# EasyEDA Pro project MushIO_V1p0_Final.eprj, schematic MushIO_V1p0_Final (continued)
## Sheets (continued)
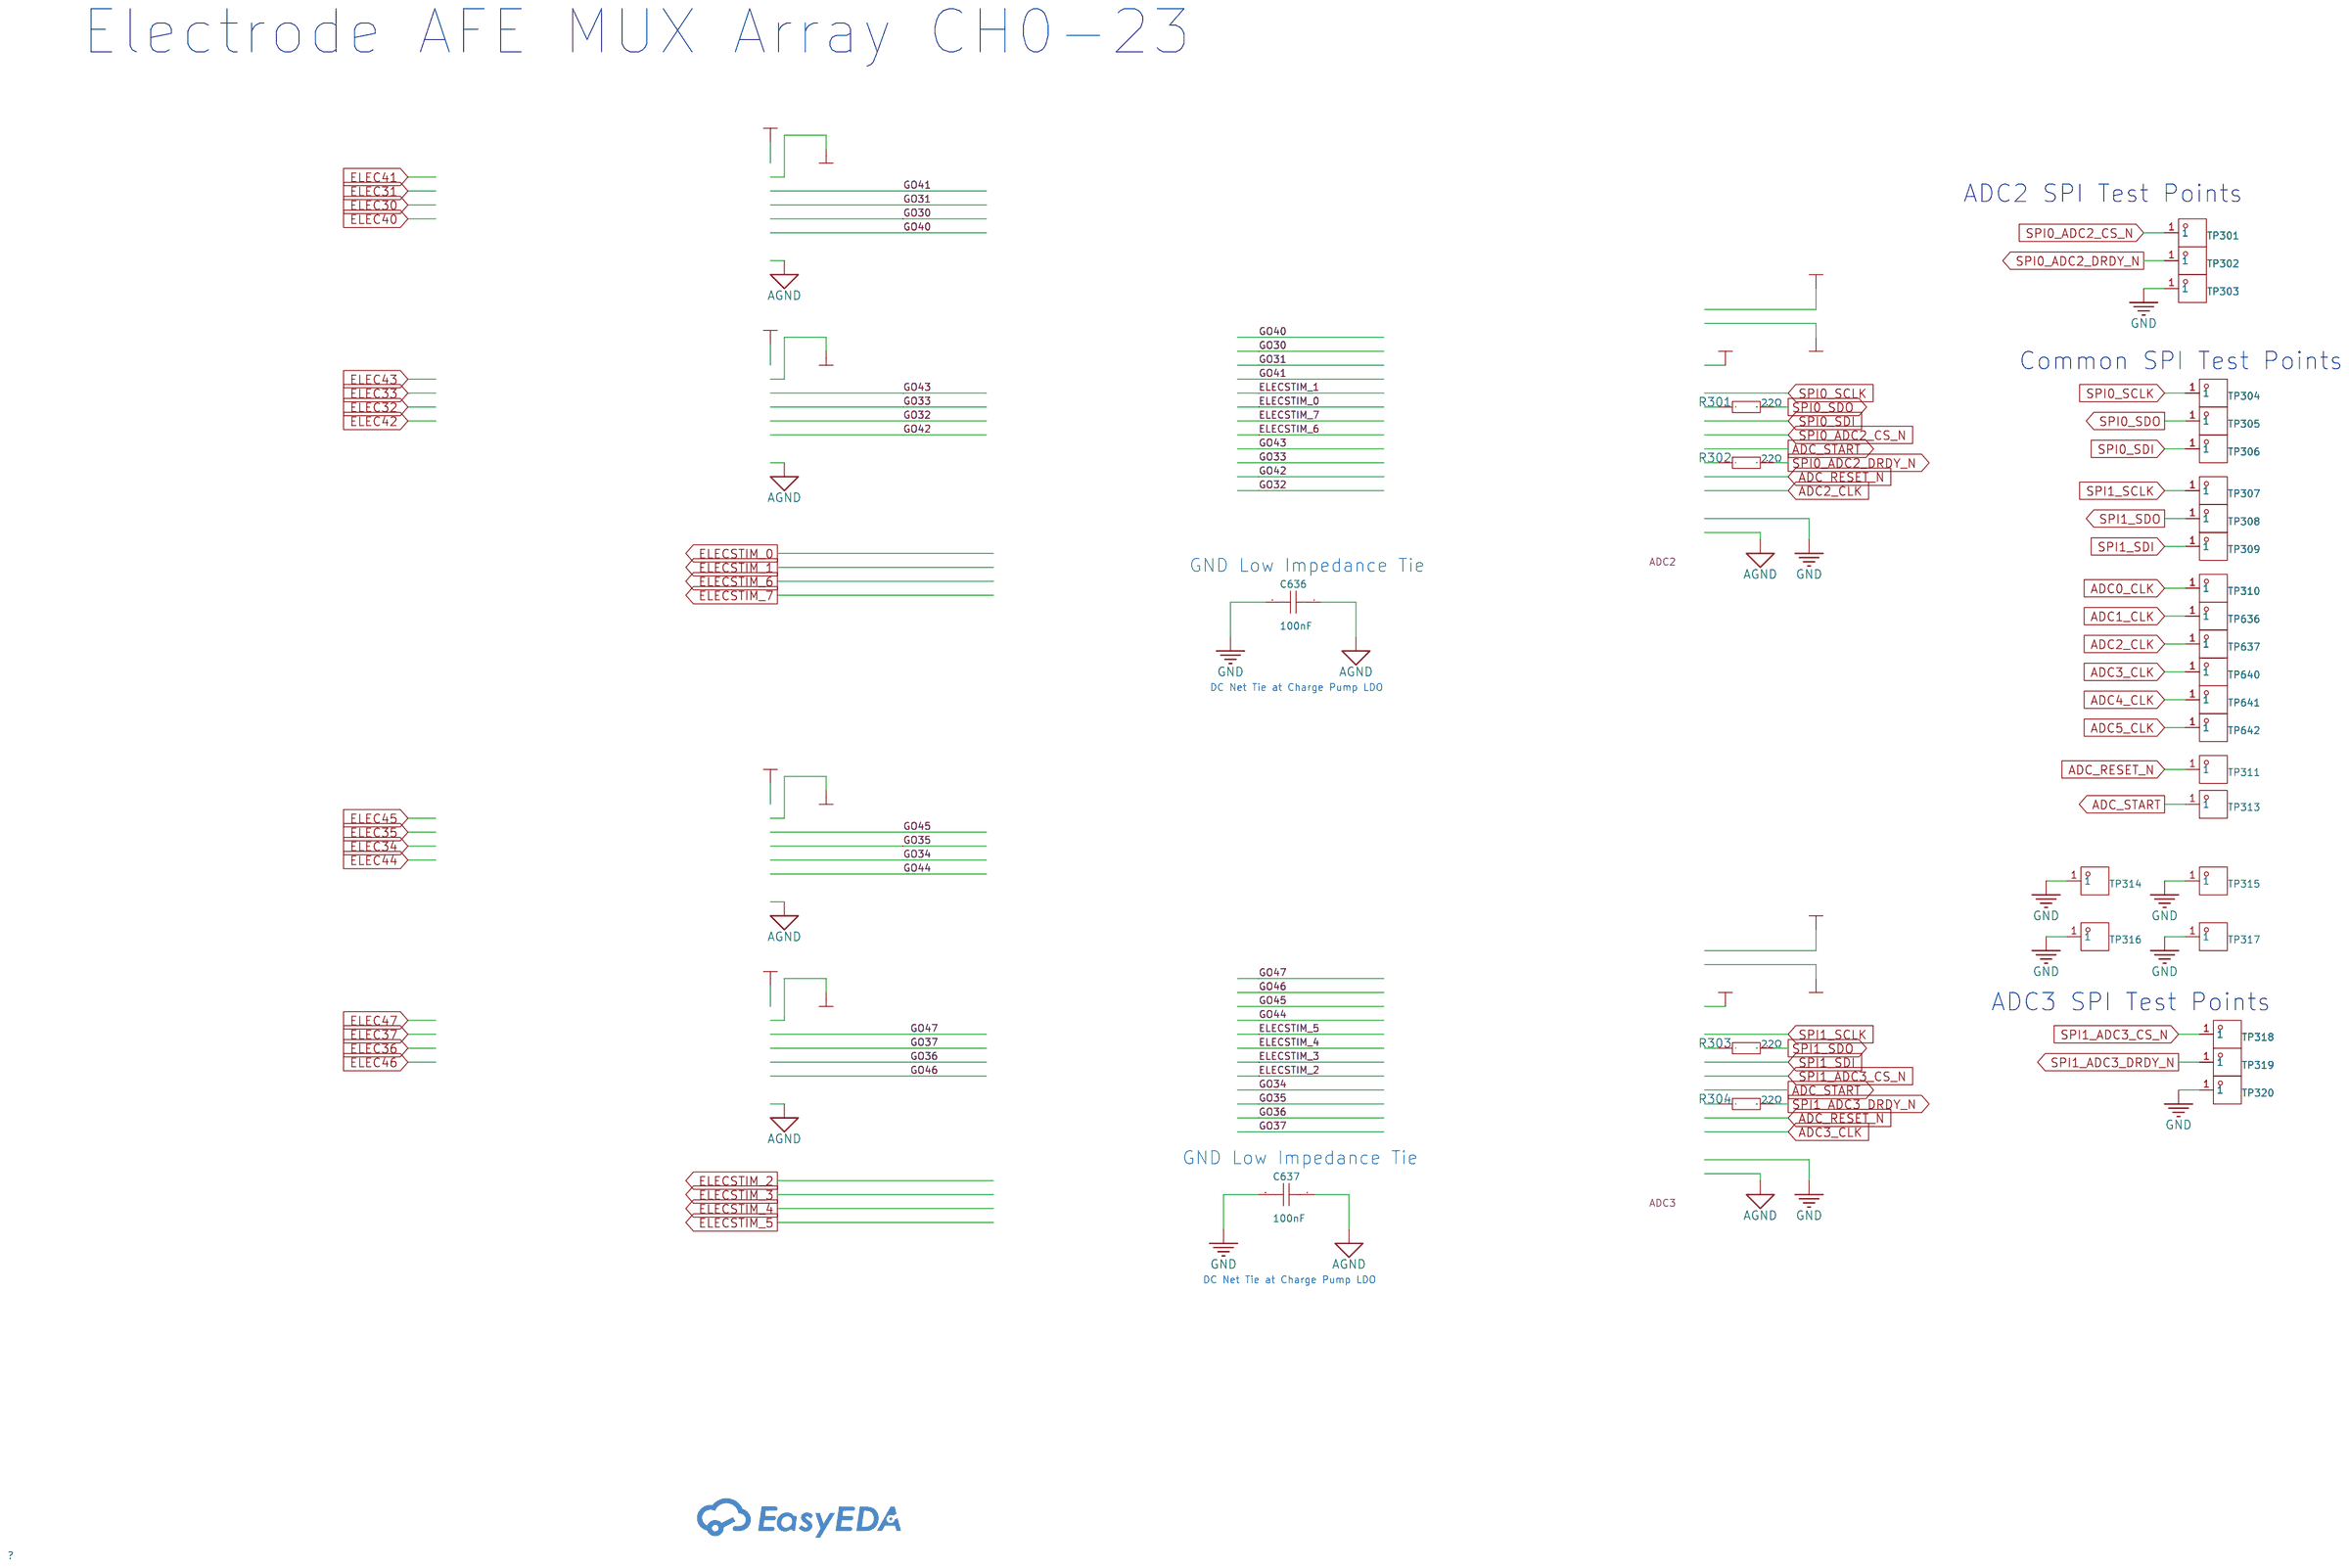
[diagram p6: AFE_ADC23]
6 AFE_ADC45: Board Name: MushIO_V1p2; Create Date: 2025-11-03; Page Name: AFE_ADC45; Project Name: MushIO_V1p2; Schematic Name: MushIO_V1p2; Update Date: 2025-12-31
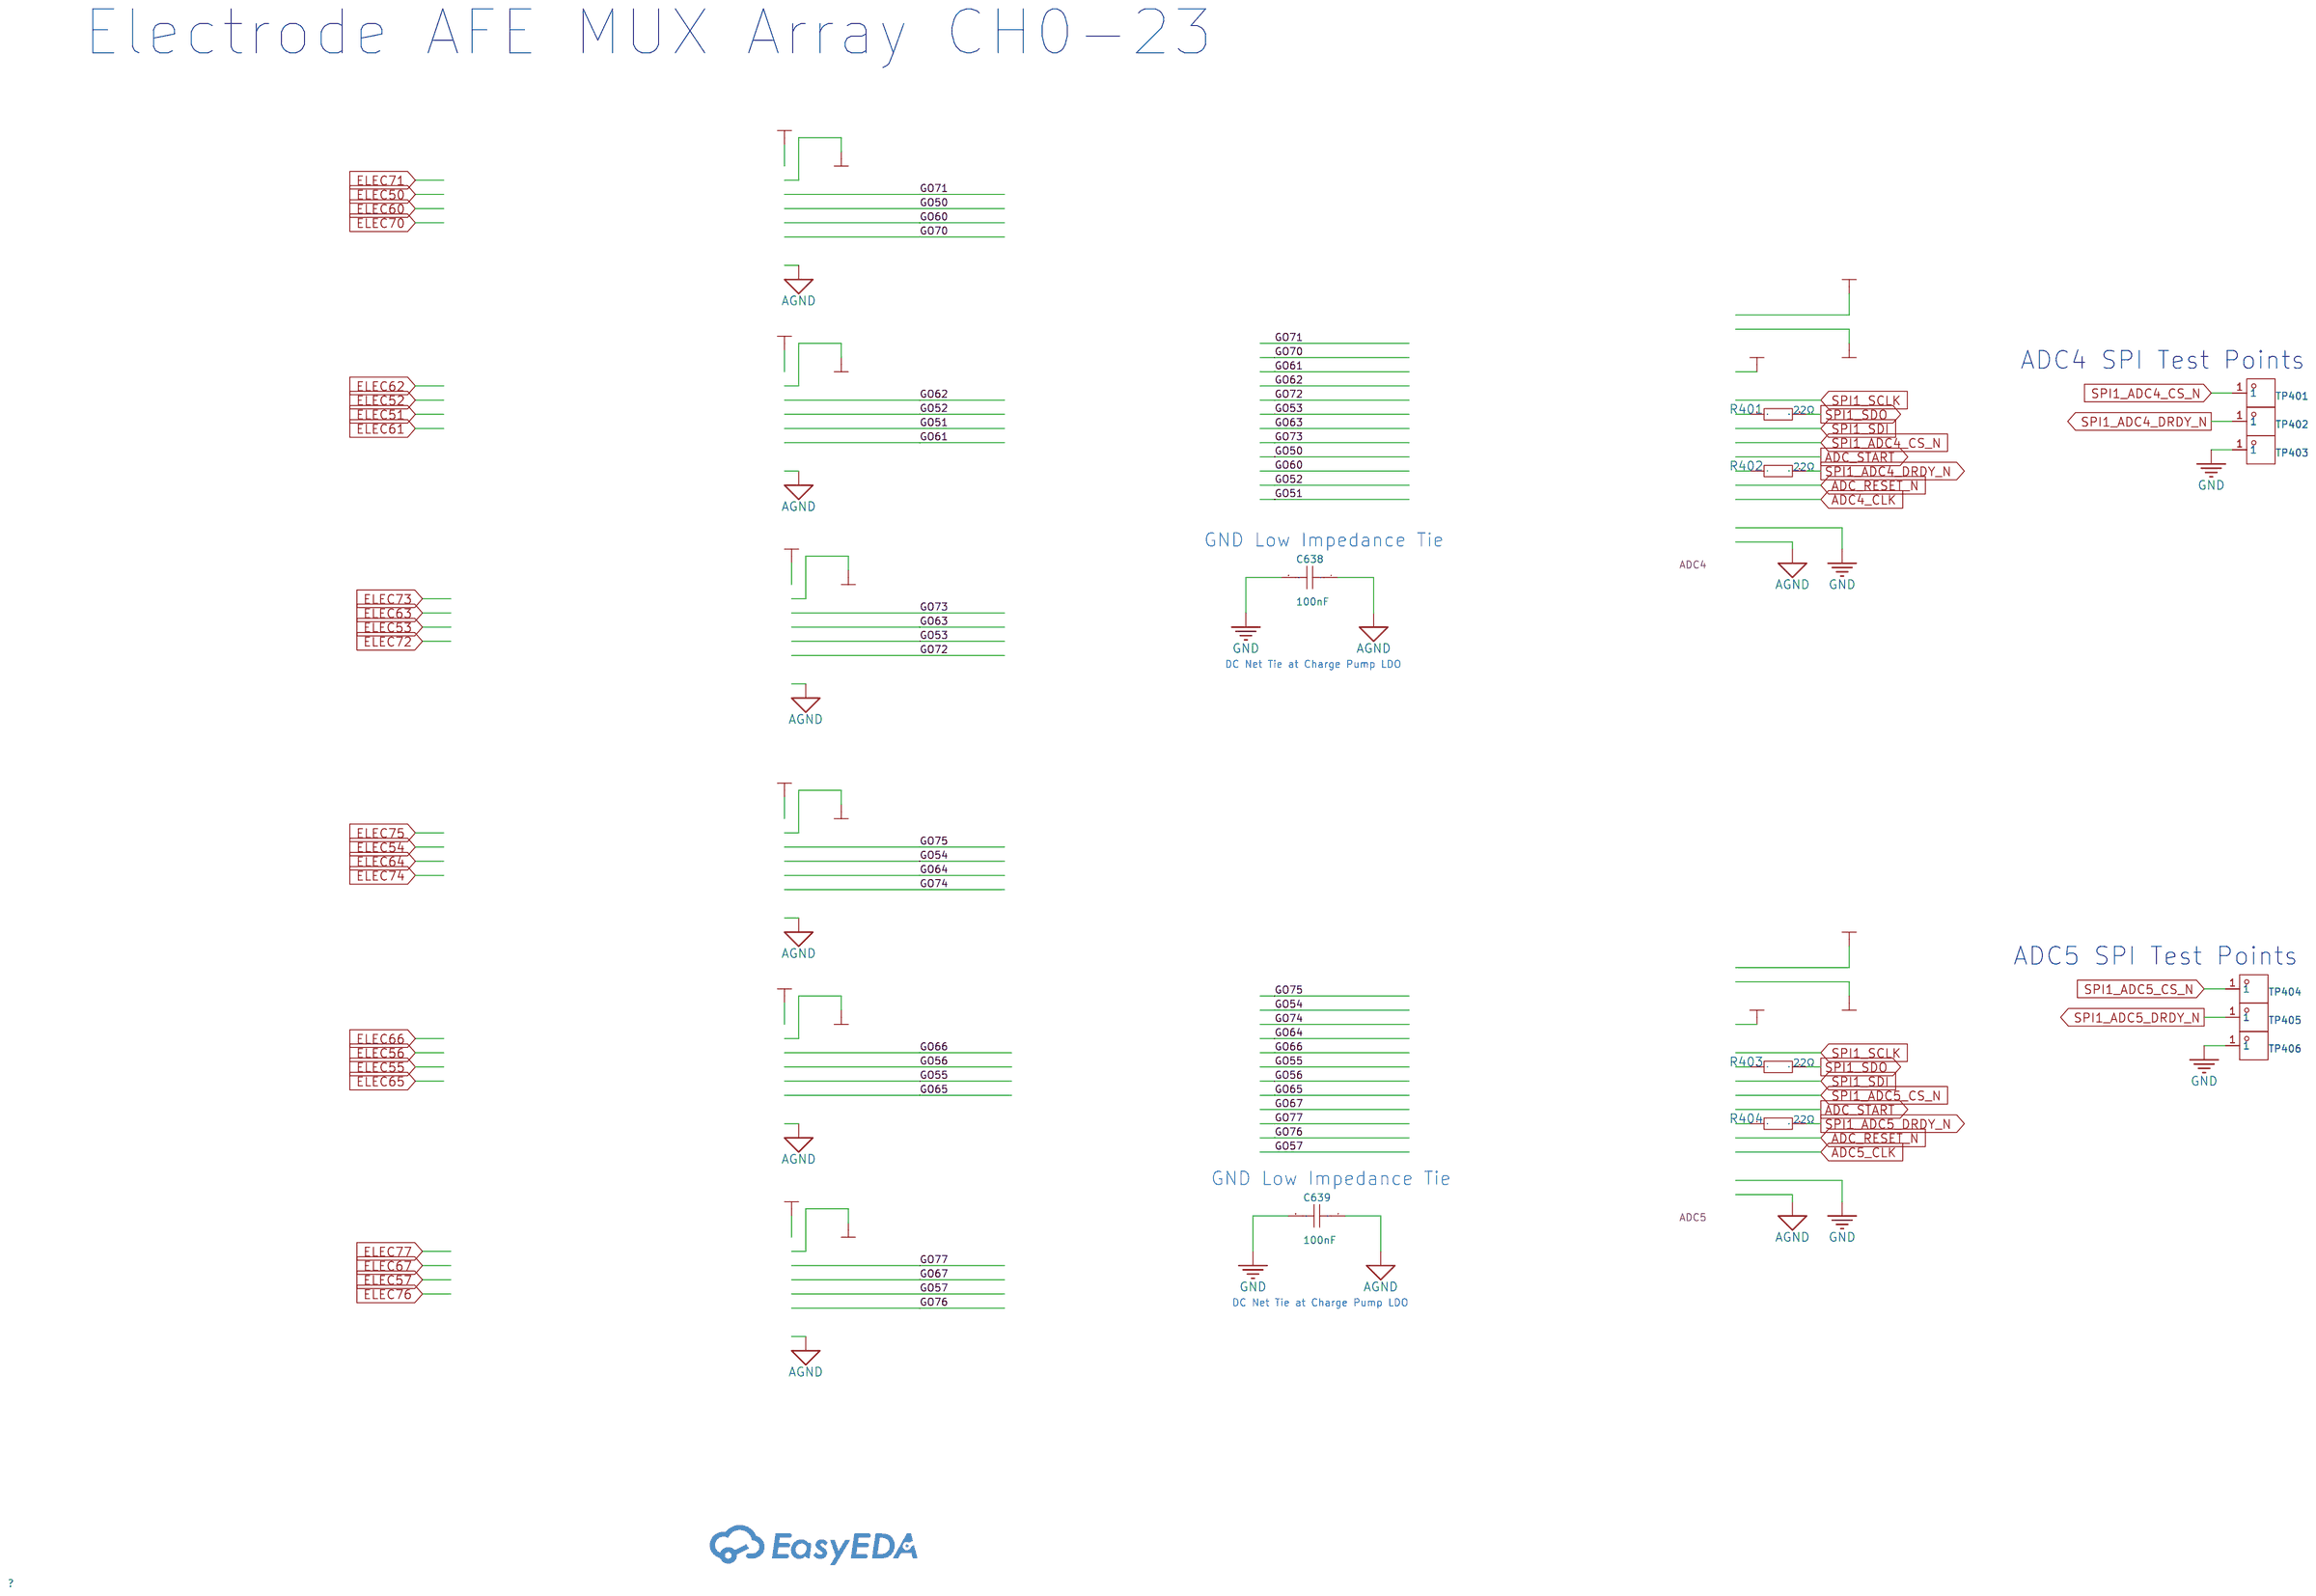
[diagram p7: AFE_ADC45]
7 Raspberry Pi Pico W: Page Name: Raspberry Pi Pico W
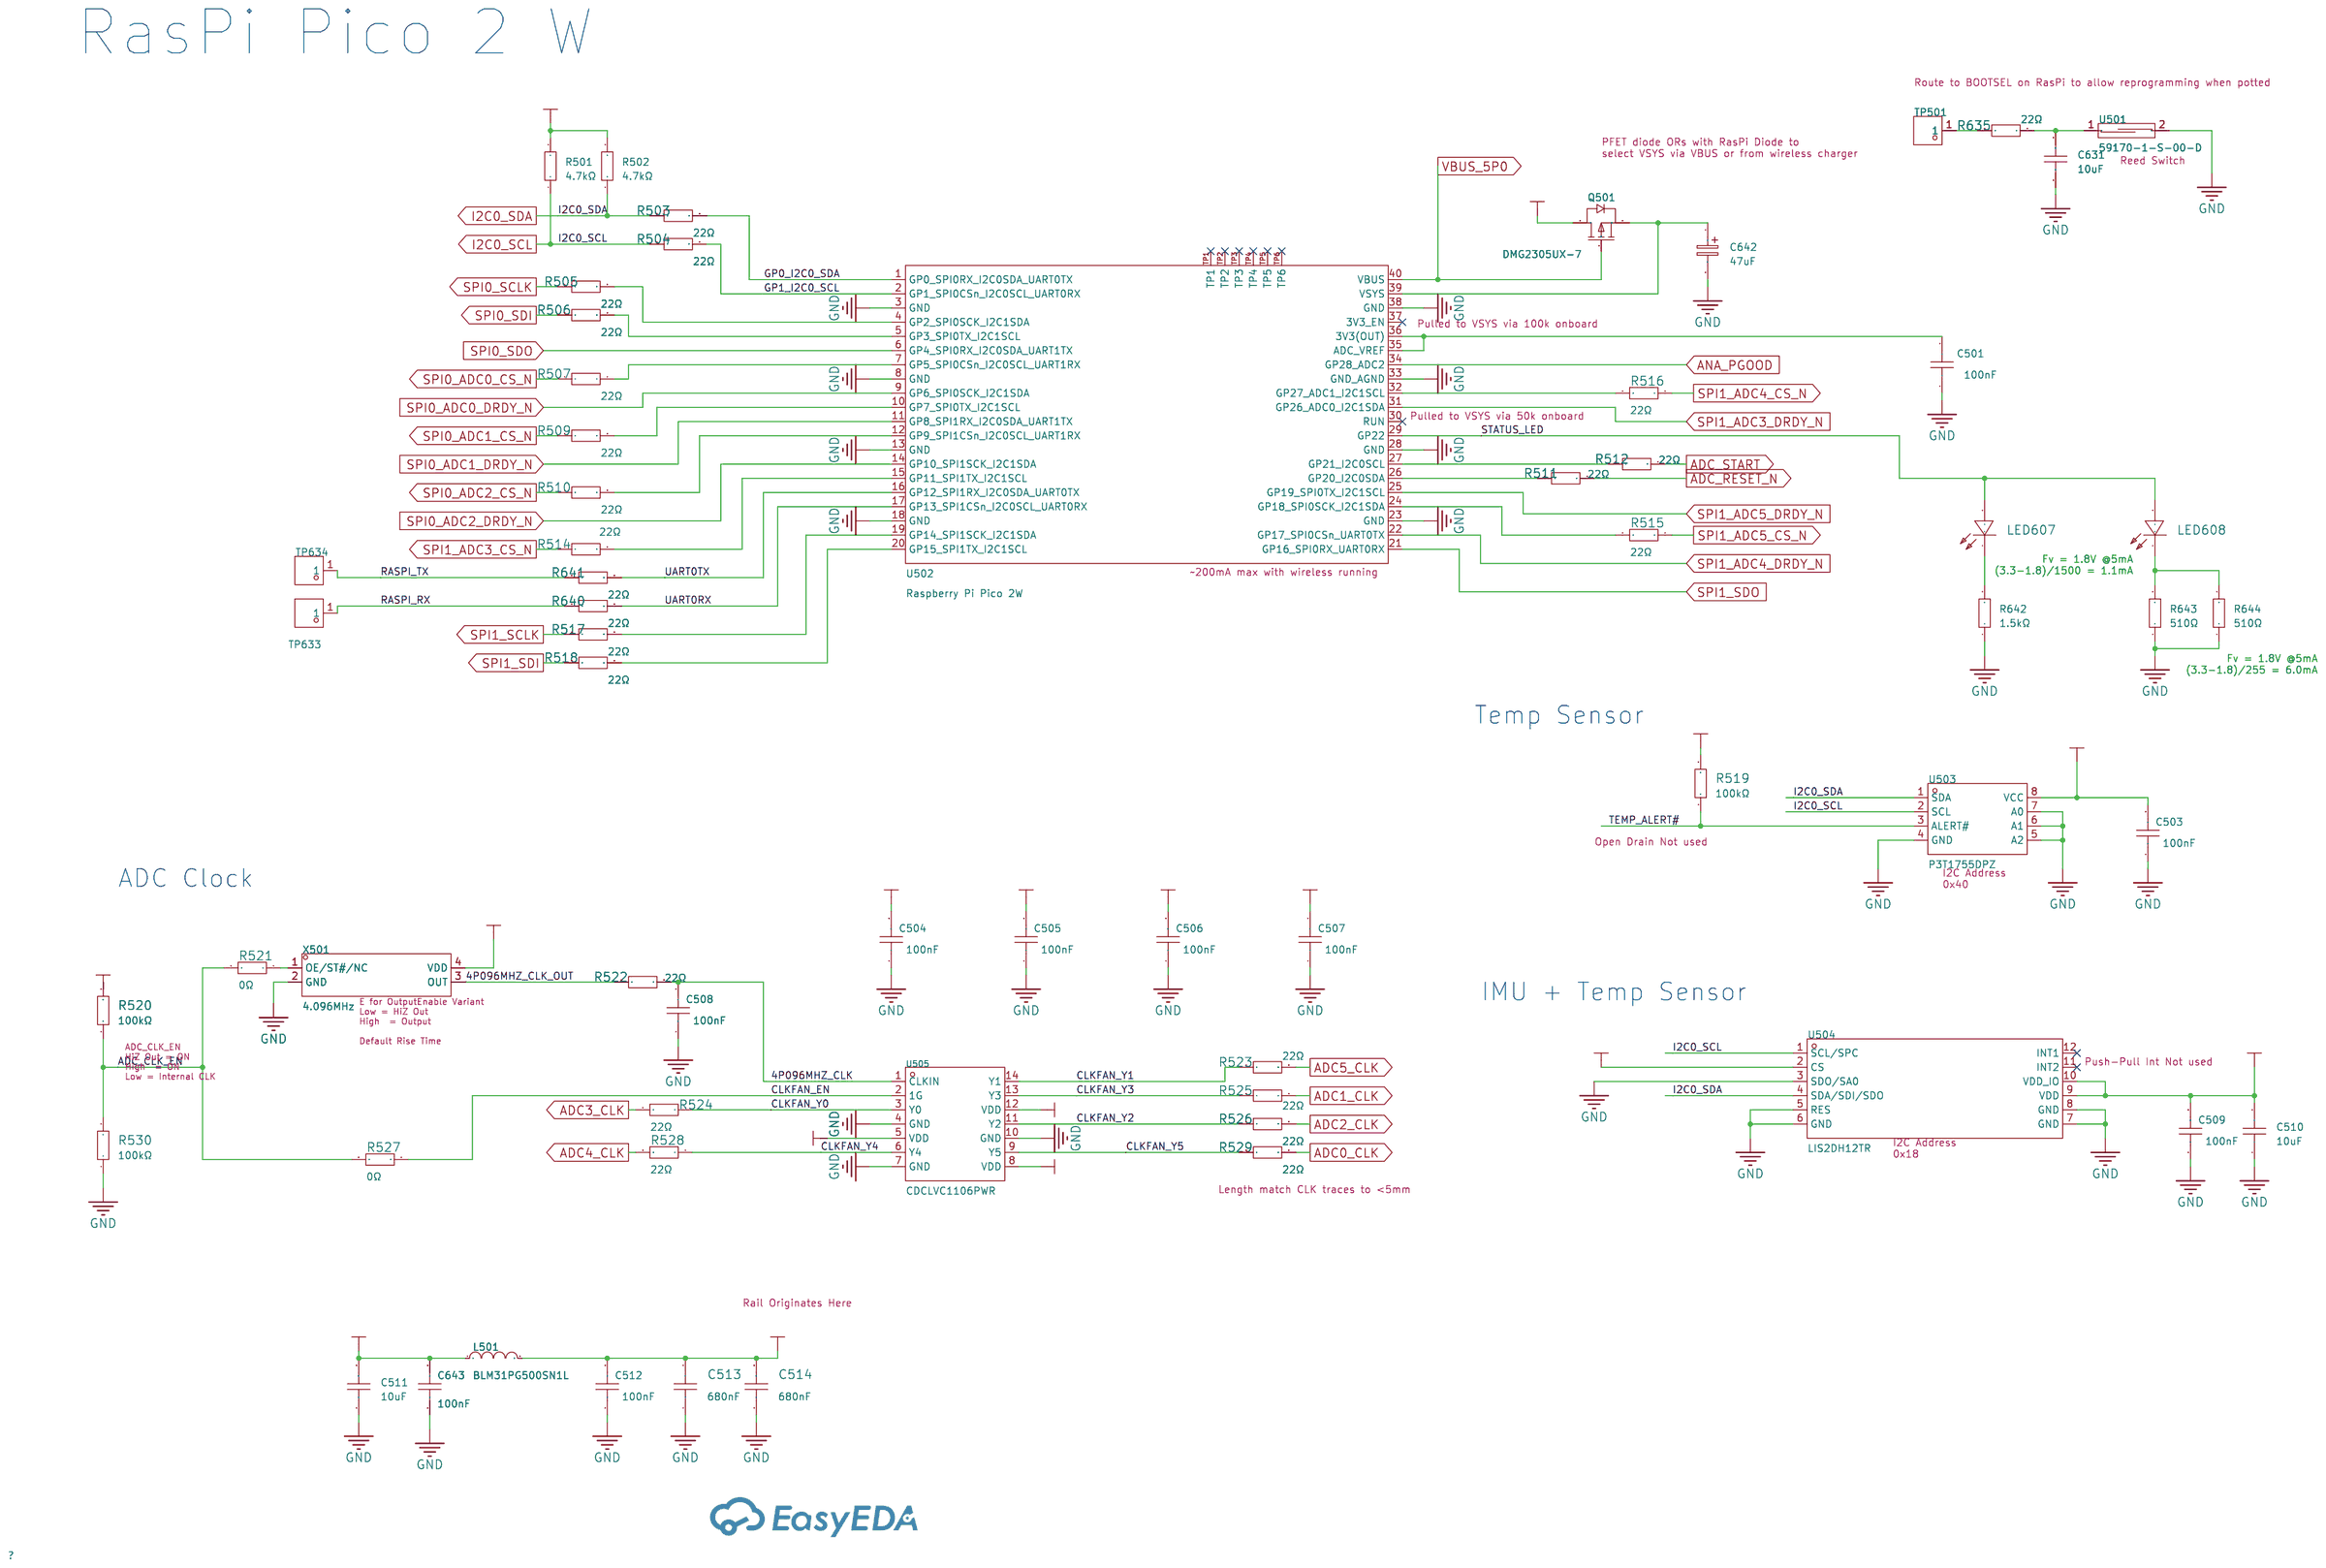
[diagram p8: Raspberry Pi Pico W]

## Parts
sheet AFE_ADC01
C634  100nF  [C0402]
C635  100nF  [C0402]
CBB1  -
CBB2  -
CBB3  -
CBB4  -
CBB5  -
CBB6  -
CBB7  -
CBB8  -
R201  22Ω  [R0402]
R202  22Ω  [R0402]
R203  22Ω  [R0402]
R204  22Ω  [R0402]
TP201  RCUCTE  [TP-SMD_RCUCTE]
TP202  RCUCTE  [TP-SMD_RCUCTE]
TP203  RCUCTE  [TP-SMD_RCUCTE]
TP204  RCUCTE  [TP-SMD_RCUCTE]
TP205  RCUCTE  [TP-SMD_RCUCTE]
TP206  RCUCTE  [TP-SMD_RCUCTE]
sheet AFE_ADC23
C636  100nF  [C0402]
C637  100nF  [C0402]
CBB9  -
CBB10  -
CBB14  -
CBB15  -
CBB18  -
CBB19  -
R301  22Ω  [R0402]
R302  22Ω  [R0402]
R303  22Ω  [R0402]
R304  22Ω  [R0402]
TP301  RCUCTE  [TP-SMD_RCUCTE]
TP302  RCUCTE  [TP-SMD_RCUCTE]
TP303  RCUCTE  [TP-SMD_RCUCTE]
TP304  RCUCTE  [TP-SMD_RCUCTE]
TP305  RCUCTE  [TP-SMD_RCUCTE]
TP306  RCUCTE  [TP-SMD_RCUCTE]
TP307  RCUCTE  [TP-SMD_RCUCTE]
TP308  RCUCTE  [TP-SMD_RCUCTE]
TP309  RCUCTE  [TP-SMD_RCUCTE]
TP310  RCUCTE  [TP-SMD_RCUCTE]
TP311  RCUCTE  [TP-SMD_RCUCTE]
TP313  RCUCTE  [TP-SMD_RCUCTE]
TP314  RCUCTE  [TP-SMD_RCUCTE]
TP315  RCUCTE  [TP-SMD_RCUCTE]
TP316  RCUCTE  [TP-SMD_RCUCTE]
TP317  RCUCTE  [TP-SMD_RCUCTE]
TP318  RCUCTE  [TP-SMD_RCUCTE]
TP319  RCUCTE  [TP-SMD_RCUCTE]
TP320  RCUCTE  [TP-SMD_RCUCTE]
TP636  RCUCTE  [TP-SMD_RCUCTE]
TP637  RCUCTE  [TP-SMD_RCUCTE]
TP640  RCUCTE  [TP-SMD_RCUCTE]
TP641  RCUCTE  [TP-SMD_RCUCTE]
TP642  RCUCTE  [TP-SMD_RCUCTE]
sheet AFE_ADC45
C638  100nF  [C0402]
C639  100nF  [C0402]
CBB20  -
CBB21  -
CBB22  -
CBB23  -
CBB24  -
CBB25  -
CBB34  -
CBB35  -
R401  22Ω  [R0402]
R402  22Ω  [R0402]
R403  22Ω  [R0402]
R404  22Ω  [R0402]
TP401  RCUCTE  [TP-SMD_RCUCTE]
TP402  RCUCTE  [TP-SMD_RCUCTE]
TP403  RCUCTE  [TP-SMD_RCUCTE]
TP404  RCUCTE  [TP-SMD_RCUCTE]
TP405  RCUCTE  [TP-SMD_RCUCTE]
TP406  RCUCTE  [TP-SMD_RCUCTE]
sheet Electrodes
CN101  1508-0-00-15-00-00-03-0  [CONN-SMD_1508-0-00-15-00-00-03-0]
CN102  1508-0-00-15-00-00-03-0  [CONN-SMD_1508-0-00-15-00-00-03-0]
CN103  1508-0-00-15-00-00-03-0  [CONN-SMD_1508-0-00-15-00-00-03-0]
CN104  1508-0-00-15-00-00-03-0  [CONN-SMD_1508-0-00-15-00-00-03-0]
CN105  1508-0-00-15-00-00-03-0  [CONN-SMD_1508-0-00-15-00-00-03-0]
CN106  1508-0-00-15-00-00-03-0  [CONN-SMD_1508-0-00-15-00-00-03-0]
CN107  1508-0-00-15-00-00-03-0  [CONN-SMD_1508-0-00-15-00-00-03-0]
CN108  1508-0-00-15-00-00-03-0  [CONN-SMD_1508-0-00-15-00-00-03-0]
CN109  1508-0-00-15-00-00-03-0  [CONN-SMD_1508-0-00-15-00-00-03-0]
CN110  1508-0-00-15-00-00-03-0  [CONN-SMD_1508-0-00-15-00-00-03-0]
CN111  1508-0-00-15-00-00-03-0  [CONN-SMD_1508-0-00-15-00-00-03-0]
CN112  1508-0-00-15-00-00-03-0  [CONN-SMD_1508-0-00-15-00-00-03-0]
CN113  1508-0-00-15-00-00-03-0  [CONN-SMD_1508-0-00-15-00-00-03-0]
CN114  1508-0-00-15-00-00-03-0  [CONN-SMD_1508-0-00-15-00-00-03-0]
CN115  1508-0-00-15-00-00-03-0  [CONN-SMD_1508-0-00-15-00-00-03-0]
CN116  1508-0-00-15-00-00-03-0  [CONN-SMD_1508-0-00-15-00-00-03-0]
CN117  1508-0-00-15-00-00-03-0  [CONN-SMD_1508-0-00-15-00-00-03-0]
CN118  1508-0-00-15-00-00-03-0  [CONN-SMD_1508-0-00-15-00-00-03-0]
CN119  1508-0-00-15-00-00-03-0  [CONN-SMD_1508-0-00-15-00-00-03-0]
CN120  1508-0-00-15-00-00-03-0  [CONN-SMD_1508-0-00-15-00-00-03-0]
CN121  1508-0-00-15-00-00-03-0  [CONN-SMD_1508-0-00-15-00-00-03-0]
CN122  1508-0-00-15-00-00-03-0  [CONN-SMD_1508-0-00-15-00-00-03-0]
CN123  1508-0-00-15-00-00-03-0  [CONN-SMD_1508-0-00-15-00-00-03-0]
CN124  1508-0-00-15-00-00-03-0  [CONN-SMD_1508-0-00-15-00-00-03-0]
CN125  1508-0-00-15-00-00-03-0  [CONN-SMD_1508-0-00-15-00-00-03-0]
CN126  1508-0-00-15-00-00-03-0  [CONN-SMD_1508-0-00-15-00-00-03-0]
CN127  1508-0-00-15-00-00-03-0  [CONN-SMD_1508-0-00-15-00-00-03-0]
CN128  1508-0-00-15-00-00-03-0  [CONN-SMD_1508-0-00-15-00-00-03-0]
CN129  1508-0-00-15-00-00-03-0  [CONN-SMD_1508-0-00-15-00-00-03-0]
CN130  1508-0-00-15-00-00-03-0  [CONN-SMD_1508-0-00-15-00-00-03-0]
CN131  1508-0-00-15-00-00-03-0  [CONN-SMD_1508-0-00-15-00-00-03-0]
CN132  1508-0-00-15-00-00-03-0  [CONN-SMD_1508-0-00-15-00-00-03-0]
CN133  1508-0-00-15-00-00-03-0  [CONN-SMD_1508-0-00-15-00-00-03-0]
CN134  1508-0-00-15-00-00-03-0  [CONN-SMD_1508-0-00-15-00-00-03-0]
CN135  1508-0-00-15-00-00-03-0  [CONN-SMD_1508-0-00-15-00-00-03-0]
CN136  1508-0-00-15-00-00-03-0  [CONN-SMD_1508-0-00-15-00-00-03-0]
CN137  1508-0-00-15-00-00-03-0  [CONN-SMD_1508-0-00-15-00-00-03-0]
CN138  1508-0-00-15-00-00-03-0  [CONN-SMD_1508-0-00-15-00-00-03-0]
CN139  1508-0-00-15-00-00-03-0  [CONN-SMD_1508-0-00-15-00-00-03-0]
CN140  1508-0-00-15-00-00-03-0  [CONN-SMD_1508-0-00-15-00-00-03-0]
CN141  1508-0-00-15-00-00-03-0  [CONN-SMD_1508-0-00-15-00-00-03-0]
CN142  1508-0-00-15-00-00-03-0  [CONN-SMD_1508-0-00-15-00-00-03-0]
CN143  1508-0-00-15-00-00-03-0  [CONN-SMD_1508-0-00-15-00-00-03-0]
CN144  1508-0-00-15-00-00-03-0  [CONN-SMD_1508-0-00-15-00-00-03-0]
CN145  1508-0-00-15-00-00-03-0  [CONN-SMD_1508-0-00-15-00-00-03-0]
CN146  1508-0-00-15-00-00-03-0  [CONN-SMD_1508-0-00-15-00-00-03-0]
CN147  1508-0-00-15-00-00-03-0  [CONN-SMD_1508-0-00-15-00-00-03-0]
CN148  1508-0-00-15-00-00-03-0  [CONN-SMD_1508-0-00-15-00-00-03-0]
CN149  1508-0-00-15-00-00-03-0  [CONN-SMD_1508-0-00-15-00-00-03-0]
CN150  1508-0-00-15-00-00-03-0  [CONN-SMD_1508-0-00-15-00-00-03-0]
CN151  1508-0-00-15-00-00-03-0  [CONN-SMD_1508-0-00-15-00-00-03-0]
CN152  1508-0-00-15-00-00-03-0  [CONN-SMD_1508-0-00-15-00-00-03-0]
CN153  1508-0-00-15-00-00-03-0  [CONN-SMD_1508-0-00-15-00-00-03-0]
CN154  1508-0-00-15-00-00-03-0  [CONN-SMD_1508-0-00-15-00-00-03-0]
CN155  1508-0-00-15-00-00-03-0  [CONN-SMD_1508-0-00-15-00-00-03-0]
CN156  1508-0-00-15-00-00-03-0  [CONN-SMD_1508-0-00-15-00-00-03-0]
CN157  1508-0-00-15-00-00-03-0  [CONN-SMD_1508-0-00-15-00-00-03-0]
CN158  1508-0-00-15-00-00-03-0  [CONN-SMD_1508-0-00-15-00-00-03-0]
CN159  1508-0-00-15-00-00-03-0  [CONN-SMD_1508-0-00-15-00-00-03-0]
CN160  1508-0-00-15-00-00-03-0  [CONN-SMD_1508-0-00-15-00-00-03-0]
CN161  1508-0-00-15-00-00-03-0  [CONN-SMD_1508-0-00-15-00-00-03-0]
CN162  1508-0-00-15-00-00-03-0  [CONN-SMD_1508-0-00-15-00-00-03-0]
CN163  1508-0-00-15-00-00-03-0  [CONN-SMD_1508-0-00-15-00-00-03-0]
CN164  1508-0-00-15-00-00-03-0  [CONN-SMD_1508-0-00-15-00-00-03-0]
CN165  1508-0-00-15-00-00-03-0  [CONN-SMD_1508-0-00-15-00-00-03-0]
CN166  1508-0-00-15-00-00-03-0  [CONN-SMD_1508-0-00-15-00-00-03-0]
CN167  1508-0-00-15-00-00-03-0  [CONN-SMD_1508-0-00-15-00-00-03-0]
CN168  1508-0-00-15-00-00-03-0  [CONN-SMD_1508-0-00-15-00-00-03-0]
CN169  1508-0-00-15-00-00-03-0  [CONN-SMD_1508-0-00-15-00-00-03-0]
CN170  1508-0-00-15-00-00-03-0  [CONN-SMD_1508-0-00-15-00-00-03-0]
CN171  1508-0-00-15-00-00-03-0  [CONN-SMD_1508-0-00-15-00-00-03-0]
CN172  1508-0-00-15-00-00-03-0  [CONN-SMD_1508-0-00-15-00-00-03-0]
CN173  1508-0-00-15-00-00-03-0  [CONN-SMD_1508-0-00-15-00-00-03-0]
CN174  1508-0-00-15-00-00-03-0  [CONN-SMD_1508-0-00-15-00-00-03-0]
CN175  1508-0-00-15-00-00-03-0  [CONN-SMD_1508-0-00-15-00-00-03-0]
CN176  1508-0-00-15-00-00-03-0  [CONN-SMD_1508-0-00-15-00-00-03-0]
CN177  1508-0-00-15-00-00-03-0  [CONN-SMD_1508-0-00-15-00-00-03-0]
L503  BLM31PG500SN1L  [L1206]
R636  0Ω  [R0402]
R637  0Ω  [R0402]
R638  0Ω  [R0402]
R639  0Ω  [R0402]
sheet Power
C601  10uF  [C0603]
C602  100nF  [C0402]
C603  10uF  [C0603]
C604  100nF  [C0402]
C605  22nF  [C0603]
C606  68nF  [C0603]
C607  470nF  [C0805]
C608  68nF  [C0603]
C609  10nF  [C0603]
C610  47nF  [C0603]
C611  10uF  [C0805]
C612  100nF  [C0603]
C613  10uF  [C0805]
C614  1.8nF  [C0603]
C615  100pF  [C0402]
C616  10nF  [C0603]
C617  470nF  [C0805]
C618  100nF  [C0603]
C619  22nF  [C0603]
C620  10uF  [C0603]
C621  100nF  [C0402]
C622  47uF  [CAP-SMD_L3.5-W2.8-R-RD]
C623  47uF  [CAP-SMD_L3.5-W2.8-R-RD]
C624  10uF  [C0603]
C625  100nF  [C0402]
C626  47uF  [CAP-SMD_L3.5-W2.8-R-RD]
C627  1uF  [C0402]
C628  10uF  [C0603]
C629  10uF  [C0603]
C630  10uF  [C0603]
C640  1uF  [C0402]
CN178  A1251WR-S-2P  [CONN-SMD_A1251WR-S-2P]
L502  BLM31PG500SN1L  [L1206]
LED601  NCD0402R1  [LED0402-RD]
LED602  NCD0402R1  [LED0402-RD]
LED603  NCD0402R1  [LED0402-RD]
LED604  NCD0402R1  [LED0402-RD]
LED605  NCD0402R1  [LED0402-RD]
LED606  NCD0402R1  [LED0402-RD]
Q601  DMG2305UX-7  [SOT-23-3_L2.9-W1.3-P1.90-LS2.4-BR]
Q602  DMG2305UX-7  [SOT-23-3_L2.9-W1.3-P1.90-LS2.4-BR]
R601  100mΩ  [R0402]
R602  1.5kΩ  [R0402]
R605  1.5kΩ  [R0402]
R606  42.2kΩ  [R0402]  (no BOM)
R607  42.2kΩ  [R0402]
R608  110Ω  [R0402]
R609  NTCS0603E3103JMT  [R0603]
R610  200Ω  [R0402]
R611  200Ω  [R0402]  (no BOM)
R612  NTCS0603E3103JMT  [R0603]
R613  0Ω  [R0402]
R614  100mΩ  [R0402]
R615  100kΩ  [R0402]
R616  0Ω  [R0402]  (no BOM)
R617  1.5kΩ  [R0402]
R618  100mΩ  [R0402]
R619  100kΩ  [R0402]
R620  100mΩ  [R0402]
R621  110kΩ  [R0402]
R622  100mΩ  [R0402]
R623  110kΩ  [R0402]
R624  100kΩ  [R0402]
R625  510Ω  [R0402]
R626  510Ω  [R0402]
R627  100kΩ  [R0402]
R628  100kΩ  [R0402]
R629  1.5kΩ  [R0402]
R630  1.5kΩ  [R0402]
R631  1.5kΩ  [R0402]
R632  510Ω  [R0402]
R633  0Ω  [R0402]  (no BOM)
R634  0Ω  [R0402]  (no BOM)
R645  0Ω  [R0402]  (no BOM)
R646  0Ω  [R0402]
TP601  RCUCTE  [TP-SMD_RCUCTE]
TP602  RCUCTE  [TP-SMD_RCUCTE]
TP603  RCUCTE  [TP-SMD_RCUCTE]  (no BOM)
TP604  RCUCTE  [TP-SMD_RCUCTE]  (no BOM)
TP607  RCUCTE  [TP-SMD_RCUCTE]
TP608  RCUCTE  [TP-SMD_RCUCTE]
TP609  RCUCTE  [TP-SMD_RCUCTE]
TP610  RCUCTE  [TP-SMD_RCUCTE]
TP611  RCUCTE  [TP-SMD_RCUCTE]
TP612  RCUCTE  [TP-SMD_RCUCTE]
TP613  RCUCTE  [TP-SMD_RCUCTE]
TP614  RCUCTE  [TP-SMD_RCUCTE]
TP615  RCUCTE  [TP-SMD_RCUCTE]
TP616  RCUCTE  [TP-SMD_RCUCTE]
TP617  RCUCTE  [TP-SMD_RCUCTE]
TP618  RCUCTE  [TP-SMD_RCUCTE]
TP619  RCUCTE  [TP-SMD_RCUCTE]
TP620  RCUCTE  [TP-SMD_RCUCTE]
TP621  RCUCTE  [TP-SMD_RCUCTE]
TP622  RCUCTE  [TP-SMD_RCUCTE]
TP623  RCUCTE  [TP-SMD_RCUCTE]
TP624  RCUCTE  [TP-SMD_RCUCTE]
TP626  RCUCTE  [TP-SMD_RCUCTE]
TP627  RCUCTE  [TP-SMD_RCUCTE]
TP628  RCUCTE  [TP-SMD_RCUCTE]
TP629  RCUCTE  [TP-SMD_RCUCTE]
TP630  RCUCTE  [TP-SMD_RCUCTE]
TP631  RCUCTE  [TP-SMD_RCUCTE]
U601  BQ24040DSQR  [WSON-10_L2.0-W2.0-P0.40-BL-EP]
U602  BQ51013CRHLR  [VQFN-20_L4.5-W3.5-P0.50-BL-EP_TI_RHL0020A]
U603  ME6217C33M5G  [SOT-23-5_L3.0-W1.7-P0.95-LS2.8-BR]
U604  LM27762DSSR  [WSON-12_L3.0-W2.0-P0.50-BL-EP]
U605  1502-2  [SMD_BD3.2-D2.3]  (no BOM)
U606  1502-2  [SMD_BD3.2-D2.3]  (no BOM)
U607  1502-2  [SMD_BD3.2-D2.3]  (no BOM)
U608  1502-2  [SMD_BD3.2-D2.3]
U609  1502-2  [SMD_BD3.2-D2.3]
U610  1502-2  [SMD_BD3.2-D2.3]
sheet Raspberry Pi Pico W
C501  100nF  [C0402]
C503  100nF  [C0402]
C504  100nF  [C0402]
C505  100nF  [C0402]
C506  100nF  [C0402]
C507  100nF  [C0402]
C508  100nF  [C0402]  (no BOM)
C509  100nF  [C0402]
C510  10uF  [C0603]
C511  10uF  [C0603]
C512  100nF  [C0402]
C513  680nF  [C0402]
C514  680nF  [C0402]
C631  10uF  [C0603]
C642  47uF  [CAP-SMD_L3.5-W2.8-R-RD]
C643  100nF  [C0402]
L501  BLM31PG500SN1L  [L1206]
LED607  NCD0402R1  [LED0402-RD]
LED608  NCD0402R1  [LED0402-RD]
Q501  DMG2305UX-7  [SOT-23-3_L2.9-W1.3-P1.90-LS2.4-BR]
R501  4.7kΩ  [R0402]
R502  4.7kΩ  [R0402]
R503  22Ω  [R0402]
R504  22Ω  [R0402]
R505  22Ω  [R0402]
R506  22Ω  [R0402]
R507  22Ω  [R0402]
R509  22Ω  [R0402]
R510  22Ω  [R0402]
R511  22Ω  [R0402]
R512  22Ω  [R0402]
R514  22Ω  [R0402]
R515  22Ω  [R0402]
R516  22Ω  [R0402]
R517  22Ω  [R0402]
R518  22Ω  [R0402]
R519  100kΩ  [R0402]
R520  100kΩ  [R0402]
R521  0Ω  [R0402]
R522  22Ω  [R0402]
R523  22Ω  [R0402]
R524  22Ω  [R0402]
R525  22Ω  [R0402]
R526  22Ω  [R0402]
R527  0Ω  [R0402]
R528  22Ω  [R0402]
R529  22Ω  [R0402]
R530  100kΩ  [R0402]  (no BOM)
R635  22Ω  [R0402]
R640  22Ω  [R0402]
R641  22Ω  [R0402]
R642  1.5kΩ  [R0402]
R643  510Ω  [R0402]
R644  510Ω  [R0402]
TP501  RCUCTE  [TP-SMD_RCUCTE]  (no BOM)
TP633  RCUCTE  [TP-SMD_RCUCTE]
TP634  RCUCTE  [TP-SMD_RCUCTE]
U501  59170-1-S-00-D  [SENSOR-SMD_59170-1-S-00-D]
U502  Raspberry Pi Pico 2W  [COMM-SMD_L51.0-W21.0-P2.54_PICOW]
U503  P3T1755DPZ  [TSSOP-8_L3.0-W3.0-P0.65-LS4.9-BL]
U504  LIS2DH12TR  [LGA-12_L2.0-W2.0-P0.50-BL]
U505  CDCLVC1106PWR  [TSSOP-14_L5.0-W4.4-P0.65-LS6.4-BL]
X501  4.096MHz  [OSC-SMD_4P-L7.0-W5.0-BL]
